# EAGLE schematic Resistor_Resistor (EAGLE 8.3.0), part 12 of 43
## Parts (continued)
R15918  10K  RESISTOR_0201  [0201]
R15919  10K  RESISTOR_0201  [0201]
R15920  10K  RESISTOR_0201  [0201]
R15921  10K  RESISTOR_0201  [0201]
R15922  10K  RESISTOR_0201  [0201]
R15923  10K  RESISTOR_0201  [0201]
R15924  10K  RESISTOR_0201  [0201]
R15925  10K  RESISTOR_0201  [0201]
R15926  10K  RESISTOR_0201  [0201]
R15927  10K  RESISTOR_0201  [0201]
R15928  10K  RESISTOR_0201  [0201]
R15929  10K  RESISTOR_0201  [0201]
R15930  10K  RESISTOR_0201  [0201]
R15931  10K  RESISTOR_0201  [0201]
R15932  10K  RESISTOR_0201  [0201]
R15933  10K  RESISTOR_0201  [0201]
R15934  10K  RESISTOR_0201  [0201]
R15935  10K  RESISTOR_0201  [0201]
R15936  10K  RESISTOR_0201  [0201]
R15937  10K  RESISTOR_0201  [0201]
R15938  10K  RESISTOR_0201  [0201]
R15939  10K  RESISTOR_0201  [0201]
R15940  10K  RESISTOR_0201  [0201]
R15941  10K  RESISTOR_0201  [0201]
R15942  10K  RESISTOR_0201  [0201]
R15943  10K  RESISTOR_0201  [0201]
R15944  10K  RESISTOR_0201  [0201]
R15945  10K  RESISTOR_0201  [0201]
R15946  10K  RESISTOR_0201  [0201]
R15947  10K  RESISTOR_0201  [0201]
R15948  10K  RESISTOR_0201  [0201]
R15949  10K  RESISTOR_0201  [0201]
R15950  10K  RESISTOR_0201  [0201]
R15951  10K  RESISTOR_0201  [0201]
R15952  10K  RESISTOR_0201  [0201]
R15953  10K  RESISTOR_0201  [0201]
R15954  10K  RESISTOR_0201  [0201]
R15955  10K  RESISTOR_0201  [0201]
R15956  10K  RESISTOR_0201  [0201]
R15957  10K  RESISTOR_0201  [0201]
R15958  10K  RESISTOR_0201  [0201]
R15959  10K  RESISTOR_0201  [0201]
R15960  10K  RESISTOR_0201  [0201]
R15961  10K  RESISTOR_0201  [0201]
R15962  10K  RESISTOR_0201  [0201]
R15963  10K  RESISTOR_0201  [0201]
R15964  10K  RESISTOR_0201  [0201]
R15965  10K  RESISTOR_0201  [0201]
R15966  10K  RESISTOR_0201  [0201]
R15967  10K  RESISTOR_0201  [0201]
R15968  10K  RESISTOR_0201  [0201]
R15969  10K  RESISTOR_0201  [0201]
R15970  10K  RESISTOR_0201  [0201]
R15971  10K  RESISTOR_0201  [0201]
R15972  10K  RESISTOR_0201  [0201]
R15973  10K  RESISTOR_0201  [0201]
R15974  10K  RESISTOR_0201  [0201]
R15975  10K  RESISTOR_0201  [0201]
R15976  10K  RESISTOR_0201  [0201]
R15977  10K  RESISTOR_0201  [0201]
R15978  10K  RESISTOR_0201  [0201]
R15979  10K  RESISTOR_0201  [0201]
R15980  10K  RESISTOR_0201  [0201]
R15981  10K  RESISTOR_0201  [0201]
R15982  10K  RESISTOR_0201  [0201]
R15983  10K  RESISTOR_0201  [0201]
R15984  10K  RESISTOR_0201  [0201]
R15985  10K  RESISTOR_0201  [0201]
R15986  10K  RESISTOR_0201  [0201]
R15987  10K  RESISTOR_0201  [0201]
R15988  10K  RESISTOR_0201  [0201]
R15989  10K  RESISTOR_0201  [0201]
R15990  10K  RESISTOR_0201  [0201]
R15991  10K  RESISTOR_0201  [0201]
R15992  10K  RESISTOR_0201  [0201]
R15993  10K  RESISTOR_0201  [0201]
R15994  10K  RESISTOR_0201  [0201]
R15995  10K  RESISTOR_0201  [0201]
R15996  10K  RESISTOR_0201  [0201]
R15997  10K  RESISTOR_0201  [0201]
R15998  10K  RESISTOR_0201  [0201]
R15999  10K  RESISTOR_0201  [0201]
R16000  10K  RESISTOR_0201  [0201]
R16001  10K  RESISTOR_0201  [0201]
R16002  10K  RESISTOR_0201  [0201]
R16003  10K  RESISTOR_0201  [0201]
R16004  10K  RESISTOR_0201  [0201]
R16005  10K  RESISTOR_0201  [0201]
R16006  10K  RESISTOR_0201  [0201]
R16007  10K  RESISTOR_0201  [0201]
R16008  10K  RESISTOR_0201  [0201]
R16009  10K  RESISTOR_0201  [0201]
R16010  10K  RESISTOR_0201  [0201]
R16011  10K  RESISTOR_0201  [0201]
R16012  10K  RESISTOR_0201  [0201]
R16013  10K  RESISTOR_0201  [0201]
R16014  10K  RESISTOR_0201  [0201]
R16015  10K  RESISTOR_0201  [0201]
R16016  10K  RESISTOR_0201  [0201]
R16017  10K  RESISTOR_0201  [0201]
R16018  10K  RESISTOR_0201  [0201]
R16019  10K  RESISTOR_0201  [0201]
R16020  10K  RESISTOR_0201  [0201]
R16021  10K  RESISTOR_0201  [0201]
R16022  10K  RESISTOR_0201  [0201]
R16023  10K  RESISTOR_0201  [0201]
R16024  10K  RESISTOR_0201  [0201]
R16025  10K  RESISTOR_0201  [0201]
R16026  10K  RESISTOR_0201  [0201]
R16027  10K  RESISTOR_0201  [0201]
R16028  10K  RESISTOR_0201  [0201]
R16029  10K  RESISTOR_0201  [0201]
R16030  10K  RESISTOR_0201  [0201]
R16031  10K  RESISTOR_0201  [0201]
R16032  10K  RESISTOR_0201  [0201]
R16033  10K  RESISTOR_0201  [0201]
R16034  10K  RESISTOR_0201  [0201]
R16035  10K  RESISTOR_0201  [0201]
R16036  10K  RESISTOR_0201  [0201]
R16037  10K  RESISTOR_0201  [0201]
R16038  10K  RESISTOR_0201  [0201]
R16039  10K  RESISTOR_0201  [0201]
R16040  10K  RESISTOR_0201  [0201]
R16041  10K  RESISTOR_0201  [0201]
R16042  10K  RESISTOR_0201  [0201]
R16043  10K  RESISTOR_0201  [0201]
R16044  10K  RESISTOR_0201  [0201]
R16045  10K  RESISTOR_0201  [0201]
R16046  10K  RESISTOR_0201  [0201]
R16047  10K  RESISTOR_0201  [0201]
R16048  10K  RESISTOR_0201  [0201]
R16049  10K  RESISTOR_0201  [0201]
R16050  10K  RESISTOR_0201  [0201]
R16051  10K  RESISTOR_0201  [0201]
R16052  10K  RESISTOR_0201  [0201]
R16053  10K  RESISTOR_0201  [0201]
R16054  10K  RESISTOR_0201  [0201]
R16055  10K  RESISTOR_0201  [0201]
R16056  10K  RESISTOR_0201  [0201]
R16057  10K  RESISTOR_0201  [0201]
R16058  10K  RESISTOR_0201  [0201]
R16059  10K  RESISTOR_0201  [0201]
R16060  10K  RESISTOR_0201  [0201]
R16061  10K  RESISTOR_0201  [0201]
R16062  10K  RESISTOR_0201  [0201]
R16063  10K  RESISTOR_0201  [0201]
R16064  10K  RESISTOR_0201  [0201]
R16065  10K  RESISTOR_0201  [0201]
R16066  10K  RESISTOR_0201  [0201]
R16067  10K  RESISTOR_0201  [0201]
R16068  10K  RESISTOR_0201  [0201]
R16069  10K  RESISTOR_0201  [0201]
R16070  10K  RESISTOR_0201  [0201]
R16071  10K  RESISTOR_0201  [0201]
R16072  10K  RESISTOR_0201  [0201]
R16073  10K  RESISTOR_0201  [0201]
R16074  10K  RESISTOR_0201  [0201]
R16075  10K  RESISTOR_0201  [0201]
R16076  10K  RESISTOR_0201  [0201]
R16077  10K  RESISTOR_0201  [0201]
R16078  10K  RESISTOR_0201  [0201]
R16079  10K  RESISTOR_0201  [0201]
R16080  10K  RESISTOR_0201  [0201]
R16081  10K  RESISTOR_0201  [0201]
R16082  10K  RESISTOR_0201  [0201]
R16083  10K  RESISTOR_0201  [0201]
R16084  10K  RESISTOR_0201  [0201]
R16085  10K  RESISTOR_0201  [0201]
R16086  10K  RESISTOR_0201  [0201]
R16087  10K  RESISTOR_0201  [0201]
R16088  10K  RESISTOR_0201  [0201]
R16089  10K  RESISTOR_0201  [0201]
R16090  10K  RESISTOR_0201  [0201]
R16091  10K  RESISTOR_0201  [0201]
R16092  10K  RESISTOR_0201  [0201]
R16093  10K  RESISTOR_0201  [0201]
R16094  10K  RESISTOR_0201  [0201]
R16095  10K  RESISTOR_0201  [0201]
R16096  10K  RESISTOR_0201  [0201]
R16097  10K  RESISTOR_0201  [0201]
R16098  10K  RESISTOR_0201  [0201]
R16099  10K  RESISTOR_0201  [0201]
R16100  10K  RESISTOR_0201  [0201]
R16101  10K  RESISTOR_0201  [0201]
R16102  10K  RESISTOR_0201  [0201]
R16103  10K  RESISTOR_0201  [0201]
R16104  10K  RESISTOR_0201  [0201]
R16105  10K  RESISTOR_0201  [0201]
R16106  10K  RESISTOR_0201  [0201]
R16107  10K  RESISTOR_0201  [0201]
R16108  10K  RESISTOR_0201  [0201]
R16109  10K  RESISTOR_0201  [0201]
R16110  10K  RESISTOR_0201  [0201]
R16111  10K  RESISTOR_0201  [0201]
R16112  10K  RESISTOR_0201  [0201]
R16113  10K  RESISTOR_0201  [0201]
R16114  10K  RESISTOR_0201  [0201]
R16115  10K  RESISTOR_0201  [0201]
R16116  10K  RESISTOR_0201  [0201]
R16117  10K  RESISTOR_0201  [0201]
R16118  10K  RESISTOR_0201  [0201]
R16119  10K  RESISTOR_0201  [0201]
R16120  10K  RESISTOR_0201  [0201]
R16121  10K  RESISTOR_0201  [0201]
R16122  10K  RESISTOR_0201  [0201]
R16123  10K  RESISTOR_0201  [0201]
R16124  10K  RESISTOR_0201  [0201]
R16125  10K  RESISTOR_0201  [0201]
R16126  10K  RESISTOR_0201  [0201]
R16127  10K  RESISTOR_0201  [0201]
R16128  10K  RESISTOR_0201  [0201]
R16129  10K  RESISTOR_0201  [0201]
R16130  10K  RESISTOR_0201  [0201]
R16131  10K  RESISTOR_0201  [0201]
R16132  10K  RESISTOR_0201  [0201]
R16133  10K  RESISTOR_0201  [0201]
R16134  10K  RESISTOR_0201  [0201]
R16135  10K  RESISTOR_0201  [0201]
R16136  10K  RESISTOR_0201  [0201]
R16137  10K  RESISTOR_0201  [0201]
R16138  10K  RESISTOR_0201  [0201]
R16139  10K  RESISTOR_0201  [0201]
R16140  10K  RESISTOR_0201  [0201]
R16141  10K  RESISTOR_0201  [0201]
R16142  10K  RESISTOR_0201  [0201]
R16143  10K  RESISTOR_0201  [0201]
R16144  10K  RESISTOR_0201  [0201]
R16145  10K  RESISTOR_0201  [0201]
R16146  10K  RESISTOR_0201  [0201]
R16147  10K  RESISTOR_0201  [0201]
R16148  10K  RESISTOR_0201  [0201]
R16149  10K  RESISTOR_0201  [0201]
R16150  10K  RESISTOR_0201  [0201]
R16151  10K  RESISTOR_0201  [0201]
R16152  10K  RESISTOR_0201  [0201]
R16153  10K  RESISTOR_0201  [0201]
R16154  10K  RESISTOR_0201  [0201]
R16155  10K  RESISTOR_0201  [0201]
R16156  10K  RESISTOR_0201  [0201]
R16157  10K  RESISTOR_0201  [0201]
R16158  10K  RESISTOR_0201  [0201]
R16159  10K  RESISTOR_0201  [0201]
R16160  10K  RESISTOR_0201  [0201]
R16161  10K  RESISTOR_0201  [0201]
R16162  10K  RESISTOR_0201  [0201]
R16163  10K  RESISTOR_0201  [0201]
R16164  10K  RESISTOR_0201  [0201]
R16165  10K  RESISTOR_0201  [0201]
R16166  10K  RESISTOR_0201  [0201]
R16167  10K  RESISTOR_0201  [0201]
R16168  10K  RESISTOR_0201  [0201]
R16169  10K  RESISTOR_0201  [0201]
R16170  10K  RESISTOR_0201  [0201]
R16171  10K  RESISTOR_0201  [0201]
R16172  10K  RESISTOR_0201  [0201]
R16173  10K  RESISTOR_0201  [0201]
R16174  10K  RESISTOR_0201  [0201]
R16175  10K  RESISTOR_0201  [0201]
R16176  10K  RESISTOR_0201  [0201]
R16177  10K  RESISTOR_0201  [0201]
R16178  10K  RESISTOR_0201  [0201]
R16179  10K  RESISTOR_0201  [0201]
R16180  10K  RESISTOR_0201  [0201]
R16181  10K  RESISTOR_0201  [0201]
R16182  10K  RESISTOR_0201  [0201]
R16183  10K  RESISTOR_0201  [0201]
R16184  10K  RESISTOR_0201  [0201]
R16185  10K  RESISTOR_0201  [0201]
R16186  10K  RESISTOR_0201  [0201]
R16187  10K  RESISTOR_0201  [0201]
R16188  10K  RESISTOR_0201  [0201]
R16189  10K  RESISTOR_0201  [0201]
R16190  10K  RESISTOR_0201  [0201]
R16191  10K  RESISTOR_0201  [0201]
R16192  10K  RESISTOR_0201  [0201]
R16193  10K  RESISTOR_0201  [0201]
R16194  10K  RESISTOR_0201  [0201]
R16195  10K  RESISTOR_0201  [0201]
R16196  10K  RESISTOR_0201  [0201]
R16197  10K  RESISTOR_0201  [0201]
R16198  10K  RESISTOR_0201  [0201]
R16199  10K  RESISTOR_0201  [0201]
R16200  10K  RESISTOR_0201  [0201]
R16201  10K  RESISTOR_0201  [0201]
R16202  10K  RESISTOR_0201  [0201]
R16203  10K  RESISTOR_0201  [0201]
R16204  10K  RESISTOR_0201  [0201]
R16205  10K  RESISTOR_0201  [0201]
R16206  10K  RESISTOR_0201  [0201]
R16207  10K  RESISTOR_0201  [0201]
R16208  10K  RESISTOR_0201  [0201]
R16209  10K  RESISTOR_0201  [0201]
R16210  10K  RESISTOR_0201  [0201]
R16211  10K  RESISTOR_0201  [0201]
R16212  10K  RESISTOR_0201  [0201]
R16213  10K  RESISTOR_0201  [0201]
R16214  10K  RESISTOR_0201  [0201]
R16215  10K  RESISTOR_0201  [0201]
R16216  10K  RESISTOR_0201  [0201]
R16217  10K  RESISTOR_0201  [0201]
R16218  10K  RESISTOR_0201  [0201]
R16219  10K  RESISTOR_0201  [0201]
R16220  10K  RESISTOR_0201  [0201]
R16221  10K  RESISTOR_0201  [0201]
R16222  10K  RESISTOR_0201  [0201]
R16223  10K  RESISTOR_0201  [0201]
R16224  10K  RESISTOR_0201  [0201]
R16225  10K  RESISTOR_0201  [0201]
R16226  10K  RESISTOR_0201  [0201]
R16227  10K  RESISTOR_0201  [0201]
R16228  10K  RESISTOR_0201  [0201]
R16229  10K  RESISTOR_0201  [0201]
R16230  10K  RESISTOR_0201  [0201]
R16231  10K  RESISTOR_0201  [0201]
R16232  10K  RESISTOR_0201  [0201]
R16233  10K  RESISTOR_0201  [0201]
R16234  10K  RESISTOR_0201  [0201]
R16235  10K  RESISTOR_0201  [0201]
R16236  10K  RESISTOR_0201  [0201]
R16237  10K  RESISTOR_0201  [0201]
R16238  10K  RESISTOR_0201  [0201]
R16239  10K  RESISTOR_0201  [0201]
R16240  10K  RESISTOR_0201  [0201]
R16241  10K  RESISTOR_0201  [0201]
R16242  10K  RESISTOR_0201  [0201]
R16243  10K  RESISTOR_0201  [0201]
R16244  10K  RESISTOR_0201  [0201]
R16245  10K  RESISTOR_0201  [0201]
R16246  10K  RESISTOR_0201  [0201]
R16247  10K  RESISTOR_0201  [0201]
R16248  10K  RESISTOR_0201  [0201]
R16249  10K  RESISTOR_0201  [0201]
R16250  10K  RESISTOR_0201  [0201]
R16251  10K  RESISTOR_0201  [0201]
R16252  10K  RESISTOR_0201  [0201]
R16253  10K  RESISTOR_0201  [0201]
R16254  10K  RESISTOR_0201  [0201]
R16255  10K  RESISTOR_0201  [0201]
R16256  10K  RESISTOR_0201  [0201]
R16257  10K  RESISTOR_0201  [0201]
R16258  10K  RESISTOR_0201  [0201]
R16259  10K  RESISTOR_0201  [0201]
R16260  10K  RESISTOR_0201  [0201]
R16261  10K  RESISTOR_0201  [0201]
R16262  10K  RESISTOR_0201  [0201]
R16263  10K  RESISTOR_0201  [0201]
R16264  10K  RESISTOR_0201  [0201]
R16265  10K  RESISTOR_0201  [0201]
R16266  10K  RESISTOR_0201  [0201]
R16267  10K  RESISTOR_0201  [0201]
R16268  10K  RESISTOR_0201  [0201]
R16269  10K  RESISTOR_0201  [0201]
R16270  10K  RESISTOR_0201  [0201]
R16271  10K  RESISTOR_0201  [0201]
R16272  10K  RESISTOR_0201  [0201]
R16273  10K  RESISTOR_0201  [0201]
R16274  10K  RESISTOR_0201  [0201]
R16275  10K  RESISTOR_0201  [0201]
R16276  10K  RESISTOR_0201  [0201]
R16277  10K  RESISTOR_0201  [0201]
R16278  10K  RESISTOR_0201  [0201]
R16279  10K  RESISTOR_0201  [0201]
R16280  10K  RESISTOR_0201  [0201]
R16281  10K  RESISTOR_0201  [0201]
R16282  10K  RESISTOR_0201  [0201]
R16283  10K  RESISTOR_0201  [0201]
R16284  10K  RESISTOR_0201  [0201]
R16285  10K  RESISTOR_0201  [0201]
R16286  10K  RESISTOR_0201  [0201]
R16287  10K  RESISTOR_0201  [0201]
R16288  10K  RESISTOR_0201  [0201]
R16289  10K  RESISTOR_0201  [0201]
R16290  10K  RESISTOR_0201  [0201]
R16291  10K  RESISTOR_0201  [0201]
R16292  10K  RESISTOR_0201  [0201]
R16293  10K  RESISTOR_0201  [0201]
R16294  10K  RESISTOR_0201  [0201]
R16295  10K  RESISTOR_0201  [0201]
R16296  10K  RESISTOR_0201  [0201]
R16297  10K  RESISTOR_0201  [0201]
R16298  10K  RESISTOR_0201  [0201]
R16299  10K  RESISTOR_0201  [0201]
R16300  10K  RESISTOR_0201  [0201]
R16301  10K  RESISTOR_0201  [0201]
R16302  10K  RESISTOR_0201  [0201]
R16303  10K  RESISTOR_0201  [0201]
R16304  10K  RESISTOR_0201  [0201]
R16305  10K  RESISTOR_0201  [0201]
R16306  10K  RESISTOR_0201  [0201]
R16307  10K  RESISTOR_0201  [0201]
R16308  10K  RESISTOR_0201  [0201]
R16309  10K  RESISTOR_0201  [0201]
R16310  10K  RESISTOR_0201  [0201]
R16311  10K  RESISTOR_0201  [0201]
R16312  10K  RESISTOR_0201  [0201]
R16313  10K  RESISTOR_0201  [0201]
R16314  10K  RESISTOR_0201  [0201]
R16315  10K  RESISTOR_0201  [0201]
R16316  10K  RESISTOR_0201  [0201]
R16317  10K  RESISTOR_0201  [0201]
R16318  10K  RESISTOR_0201  [0201]
R16319  10K  RESISTOR_0201  [0201]
R16320  10K  RESISTOR_0201  [0201]
R16321  10K  RESISTOR_0201  [0201]
R16322  10K  RESISTOR_0201  [0201]
R16323  10K  RESISTOR_0201  [0201]
R16324  10K  RESISTOR_0201  [0201]
R16325  10K  RESISTOR_0201  [0201]
R16326  10K  RESISTOR_0201  [0201]
R16327  10K  RESISTOR_0201  [0201]
R16328  10K  RESISTOR_0201  [0201]
R16329  10K  RESISTOR_0201  [0201]
R16330  10K  RESISTOR_0201  [0201]
R16331  10K  RESISTOR_0201  [0201]
R16332  10K  RESISTOR_0201  [0201]
R16333  10K  RESISTOR_0201  [0201]
R16334  10K  RESISTOR_0201  [0201]
R16335  10K  RESISTOR_0201  [0201]
R16336  10K  RESISTOR_0201  [0201]
R16337  10K  RESISTOR_0201  [0201]
R16338  10K  RESISTOR_0201  [0201]
R16339  10K  RESISTOR_0201  [0201]
R16340  10K  RESISTOR_0201  [0201]
R16341  10K  RESISTOR_0201  [0201]
R16342  10K  RESISTOR_0201  [0201]
R16343  10K  RESISTOR_0201  [0201]
R16344  10K  RESISTOR_0201  [0201]
R16345  10K  RESISTOR_0201  [0201]
R16346  10K  RESISTOR_0201  [0201]
R16347  10K  RESISTOR_0201  [0201]
R16348  10K  RESISTOR_0201  [0201]
R16349  10K  RESISTOR_0201  [0201]
R16350  10K  RESISTOR_0201  [0201]
R16351  10K  RESISTOR_0201  [0201]
R16352  10K  RESISTOR_0201  [0201]
R16353  10K  RESISTOR_0201  [0201]
R16354  10K  RESISTOR_0201  [0201]
R16355  10K  RESISTOR_0201  [0201]
R16356  10K  RESISTOR_0201  [0201]
R16357  10K  RESISTOR_0201  [0201]
R16358  10K  RESISTOR_0201  [0201]
R16359  10K  RESISTOR_0201  [0201]
R16360  10K  RESISTOR_0201  [0201]
R16361  10K  RESISTOR_0201  [0201]
R16362  10K  RESISTOR_0201  [0201]
R16363  10K  RESISTOR_0201  [0201]
R16364  10K  RESISTOR_0201  [0201]
R16365  10K  RESISTOR_0201  [0201]
R16366  10K  RESISTOR_0201  [0201]
R16367  10K  RESISTOR_0201  [0201]
R16368  10K  RESISTOR_0201  [0201]
R16369  10K  RESISTOR_0201  [0201]
R16370  10K  RESISTOR_0201  [0201]
R16371  10K  RESISTOR_0201  [0201]
R16372  10K  RESISTOR_0201  [0201]
R16373  10K  RESISTOR_0201  [0201]
R16374  10K  RESISTOR_0201  [0201]
R16375  10K  RESISTOR_0201  [0201]
R16376  10K  RESISTOR_0201  [0201]
R16377  10K  RESISTOR_0201  [0201]
R16378  10K  RESISTOR_0201  [0201]
R16379  10K  RESISTOR_0201  [0201]
R16380  10K  RESISTOR_0201  [0201]
R16381  10K  RESISTOR_0201  [0201]
R16382  10K  RESISTOR_0201  [0201]
R16383  10K  RESISTOR_0201  [0201]
R16384  10K  RESISTOR_0201  [0201]
R16385  10K  RESISTOR_0201  [0201]
R16386  10K  RESISTOR_0201  [0201]
R16387  10K  RESISTOR_0201  [0201]
R16388  10K  RESISTOR_0201  [0201]
R16389  10K  RESISTOR_0201  [0201]
R16390  10K  RESISTOR_0201  [0201]
R16391  10K  RESISTOR_0201  [0201]
R16392  10K  RESISTOR_0201  [0201]
R16393  10K  RESISTOR_0201  [0201]
R16394  10K  RESISTOR_0201  [0201]
R16395  10K  RESISTOR_0201  [0201]
R16396  10K  RESISTOR_0201  [0201]
R16397  10K  RESISTOR_0201  [0201]
R16398  10K  RESISTOR_0201  [0201]
R16399  10K  RESISTOR_0201  [0201]
R16400  10K  RESISTOR_0201  [0201]
R16401  10K  RESISTOR_0201  [0201]
R16402  10K  RESISTOR_0201  [0201]
R16403  10K  RESISTOR_0201  [0201]
R16404  10K  RESISTOR_0201  [0201]
R16405  10K  RESISTOR_0201  [0201]
R16406  10K  RESISTOR_0201  [0201]
R16407  10K  RESISTOR_0201  [0201]
R16408  10K  RESISTOR_0201  [0201]
R16409  10K  RESISTOR_0201  [0201]
R16410  10K  RESISTOR_0201  [0201]
R16411  10K  RESISTOR_0201  [0201]
R16412  10K  RESISTOR_0201  [0201]
R16413  10K  RESISTOR_0201  [0201]
R16414  10K  RESISTOR_0201  [0201]
R16415  10K  RESISTOR_0201  [0201]
R16416  10K  RESISTOR_0201  [0201]
R16417  10K  RESISTOR_0201  [0201]
R16418  10K  RESISTOR_0201  [0201]
R16419  10K  RESISTOR_0201  [0201]
R16420  10K  RESISTOR_0201  [0201]
R16421  10K  RESISTOR_0201  [0201]
R16422  10K  RESISTOR_0201  [0201]
R16423  10K  RESISTOR_0201  [0201]
R16424  10K  RESISTOR_0201  [0201]
R16425  10K  RESISTOR_0201  [0201]
R16426  10K  RESISTOR_0201  [0201]
R16427  10K  RESISTOR_0201  [0201]
R16428  10K  RESISTOR_0201  [0201]
R16429  10K  RESISTOR_0201  [0201]
R16430  10K  RESISTOR_0201  [0201]
R16431  10K  RESISTOR_0201  [0201]
R16432  10K  RESISTOR_0201  [0201]
R16433  10K  RESISTOR_0201  [0201]
R16434  10K  RESISTOR_0201  [0201]
R16435  10K  RESISTOR_0201  [0201]
R16436  10K  RESISTOR_0201  [0201]
R16437  10K  RESISTOR_0201  [0201]
R16438  10K  RESISTOR_0201  [0201]
R16439  10K  RESISTOR_0201  [0201]
R16440  10K  RESISTOR_0201  [0201]
R16441  10K  RESISTOR_0201  [0201]
R16442  10K  RESISTOR_0201  [0201]
R16443  10K  RESISTOR_0201  [0201]
R16444  10K  RESISTOR_0201  [0201]
R16445  10K  RESISTOR_0201  [0201]
R16446  10K  RESISTOR_0201  [0201]
R16447  10K  RESISTOR_0201  [0201]
R16448  10K  RESISTOR_0201  [0201]
R16449  10K  RESISTOR_0201  [0201]
R16450  10K  RESISTOR_0201  [0201]
R16451  10K  RESISTOR_0201  [0201]
R16452  10K  RESISTOR_0201  [0201]
R16453  10K  RESISTOR_0201  [0201]
R16454  10K  RESISTOR_0201  [0201]
R16455  10K  RESISTOR_0201  [0201]
R16456  10K  RESISTOR_0201  [0201]
R16457  10K  RESISTOR_0201  [0201]
R16458  10K  RESISTOR_0201  [0201]
R16459  10K  RESISTOR_0201  [0201]
R16460  10K  RESISTOR_0201  [0201]
R16461  10K  RESISTOR_0201  [0201]
R16462  10K  RESISTOR_0201  [0201]
R16463  10K  RESISTOR_0201  [0201]
R16464  10K  RESISTOR_0201  [0201]
R16465  10K  RESISTOR_0201  [0201]
R16466  10K  RESISTOR_0201  [0201]
R16467  10K  RESISTOR_0201  [0201]
R16468  10K  RESISTOR_0201  [0201]
R16469  10K  RESISTOR_0201  [0201]
R16470  10K  RESISTOR_0201  [0201]
R16471  10K  RESISTOR_0201  [0201]
R16472  10K  RESISTOR_0201  [0201]
R16473  10K  RESISTOR_0201  [0201]
R16474  10K  RESISTOR_0201  [0201]
R16475  10K  RESISTOR_0201  [0201]
R16476  10K  RESISTOR_0201  [0201]
R16477  10K  RESISTOR_0201  [0201]
R16478  10K  RESISTOR_0201  [0201]
R16479  10K  RESISTOR_0201  [0201]
R16480  10K  RESISTOR_0201  [0201]
R16481  10K  RESISTOR_0201  [0201]
R16482  10K  RESISTOR_0201  [0201]
R16483  10K  RESISTOR_0201  [0201]
R16484  10K  RESISTOR_0201  [0201]
R16485  10K  RESISTOR_0201  [0201]
R16486  10K  RESISTOR_0201  [0201]
R16487  10K  RESISTOR_0201  [0201]
R16488  10K  RESISTOR_0201  [0201]
R16489  10K  RESISTOR_0201  [0201]
R16490  10K  RESISTOR_0201  [0201]
R16491  10K  RESISTOR_0201  [0201]
R16492  10K  RESISTOR_0201  [0201]
R16493  10K  RESISTOR_0201  [0201]
R16494  10K  RESISTOR_0201  [0201]
R16495  10K  RESISTOR_0201  [0201]
R16496  10K  RESISTOR_0201  [0201]
R16497  10K  RESISTOR_0201  [0201]
R16498  10K  RESISTOR_0201  [0201]
R16499  10K  RESISTOR_0201  [0201]
R16500  10K  RESISTOR_0201  [0201]
R16501  10K  RESISTOR_0201  [0201]
R16502  10K  RESISTOR_0201  [0201]
R16503  10K  RESISTOR_0201  [0201]
R16504  10K  RESISTOR_0201  [0201]
R16505  10K  RESISTOR_0201  [0201]
R16506  10K  RESISTOR_0201  [0201]
R16507  10K  RESISTOR_0201  [0201]
R16508  10K  RESISTOR_0201  [0201]
R16509  10K  RESISTOR_0201  [0201]
R16510  10K  RESISTOR_0201  [0201]
R16511  10K  RESISTOR_0201  [0201]
R16512  10K  RESISTOR_0201  [0201]
R16513  10K  RESISTOR_0201  [0201]
R16514  10K  RESISTOR_0201  [0201]
R16515  10K  RESISTOR_0201  [0201]
R16516  10K  RESISTOR_0201  [0201]
R16517  10K  RESISTOR_0201  [0201]
R16518  10K  RESISTOR_0201  [0201]
R16519  10K  RESISTOR_0201  [0201]
R16520  10K  RESISTOR_0201  [0201]
R16521  10K  RESISTOR_0201  [0201]
R16522  10K  RESISTOR_0201  [0201]
R16523  10K  RESISTOR_0201  [0201]
R16524  10K  RESISTOR_0201  [0201]
R16525  10K  RESISTOR_0201  [0201]
R16526  10K  RESISTOR_0201  [0201]
R16527  10K  RESISTOR_0201  [0201]
R16528  10K  RESISTOR_0201  [0201]
R16529  10K  RESISTOR_0201  [0201]
R16530  10K  RESISTOR_0201  [0201]
R16531  10K  RESISTOR_0201  [0201]
R16532  10K  RESISTOR_0201  [0201]
R16533  10K  RESISTOR_0201  [0201]
R16534  10K  RESISTOR_0201  [0201]
R16535  10K  RESISTOR_0201  [0201]
R16536  10K  RESISTOR_0201  [0201]
R16537  10K  RESISTOR_0201  [0201]
R16538  10K  RESISTOR_0201  [0201]
R16539  10K  RESISTOR_0201  [0201]
R16540  10K  RESISTOR_0201  [0201]
R16541  10K  RESISTOR_0201  [0201]
R16542  10K  RESISTOR_0201  [0201]
R16543  10K  RESISTOR_0201  [0201]
R16544  10K  RESISTOR_0201  [0201]
R16545  10K  RESISTOR_0201  [0201]
R16546  10K  RESISTOR_0201  [0201]
R16547  10K  RESISTOR_0201  [0201]
R16548  10K  RESISTOR_0201  [0201]
R16549  10K  RESISTOR_0201  [0201]
R16550  10K  RESISTOR_0201  [0201]
R16551  10K  RESISTOR_0201  [0201]
R16552  10K  RESISTOR_0201  [0201]
R16553  10K  RESISTOR_0201  [0201]
R16554  10K  RESISTOR_0201  [0201]
R16555  10K  RESISTOR_0201  [0201]
R16556  10K  RESISTOR_0201  [0201]
R16557  10K  RESISTOR_0201  [0201]
R16558  10K  RESISTOR_0201  [0201]
R16559  10K  RESISTOR_0201  [0201]
R16560  10K  RESISTOR_0201  [0201]
R16561  10K  RESISTOR_0201  [0201]
R16562  10K  RESISTOR_0201  [0201]
R16563  10K  RESISTOR_0201  [0201]
R16564  10K  RESISTOR_0201  [0201]
R16565  10K  RESISTOR_0201  [0201]
R16566  10K  RESISTOR_0201  [0201]
R16567  10K  RESISTOR_0201  [0201]
R16568  10K  RESISTOR_0201  [0201]
R16569  10K  RESISTOR_0201  [0201]
R16570  10K  RESISTOR_0201  [0201]
R16571  10K  RESISTOR_0201  [0201]
R16572  10K  RESISTOR_0201  [0201]
R16573  10K  RESISTOR_0201  [0201]
R16574  10K  RESISTOR_0201  [0201]
R16575  10K  RESISTOR_0201  [0201]
R16576  10K  RESISTOR_0201  [0201]
R16577  10K  RESISTOR_0201  [0201]
R16578  10K  RESISTOR_0201  [0201]
R16579  10K  RESISTOR_0201  [0201]
R16580  10K  RESISTOR_0201  [0201]
R16581  10K  RESISTOR_0201  [0201]
R16582  10K  RESISTOR_0201  [0201]
R16583  10K  RESISTOR_0201  [0201]
R16584  10K  RESISTOR_0201  [0201]
R16585  10K  RESISTOR_0201  [0201]
R16586  10K  RESISTOR_0201  [0201]
R16587  10K  RESISTOR_0201  [0201]
R16588  10K  RESISTOR_0201  [0201]
R16589  10K  RESISTOR_0201  [0201]
R16590  10K  RESISTOR_0201  [0201]
R16591  10K  RESISTOR_0201  [0201]
R16592  10K  RESISTOR_0201  [0201]
R16593  10K  RESISTOR_0201  [0201]
R16594  10K  RESISTOR_0201  [0201]
R16595  10K  RESISTOR_0201  [0201]
R16596  10K  RESISTOR_0201  [0201]
R16597  10K  RESISTOR_0201  [0201]
R16598  10K  RESISTOR_0201  [0201]
R16599  10K  RESISTOR_0201  [0201]
R16600  10K  RESISTOR_0201  [0201]
R16601  10K  RESISTOR_0201  [0201]
R16602  10K  RESISTOR_0201  [0201]
R16603  10K  RESISTOR_0201  [0201]
R16604  10K  RESISTOR_0201  [0201]
R16605  10K  RESISTOR_0201  [0201]
R16606  10K  RESISTOR_0201  [0201]
R16607  10K  RESISTOR_0201  [0201]
R16608  10K  RESISTOR_0201  [0201]
R16609  10K  RESISTOR_0201  [0201]
R16610  10K  RESISTOR_0201  [0201]
R16611  10K  RESISTOR_0201  [0201]
R16612  10K  RESISTOR_0201  [0201]
R16613  10K  RESISTOR_0201  [0201]
R16614  10K  RESISTOR_0201  [0201]
R16615  10K  RESISTOR_0201  [0201]
R16616  10K  RESISTOR_0201  [0201]
R16617  10K  RESISTOR_0201  [0201]
R16618  10K  RESISTOR_0201  [0201]
R16619  10K  RESISTOR_0201  [0201]
R16620  10K  RESISTOR_0201  [0201]
R16621  10K  RESISTOR_0201  [0201]
R16622  10K  RESISTOR_0201  [0201]
R16623  10K  RESISTOR_0201  [0201]
R16624  10K  RESISTOR_0201  [0201]
R16625  10K  RESISTOR_0201  [0201]
R16626  10K  RESISTOR_0201  [0201]
R16627  10K  RESISTOR_0201  [0201]
R16628  10K  RESISTOR_0201  [0201]
R16629  10K  RESISTOR_0201  [0201]
R16630  10K  RESISTOR_0201  [0201]
R16631  10K  RESISTOR_0201  [0201]
R16632  10K  RESISTOR_0201  [0201]
R16633  10K  RESISTOR_0201  [0201]
R16634  10K  RESISTOR_0201  [0201]
R16635  10K  RESISTOR_0201  [0201]
R16636  10K  RESISTOR_0201  [0201]
R16637  10K  RESISTOR_0201  [0201]
R16638  10K  RESISTOR_0201  [0201]
R16639  10K  RESISTOR_0201  [0201]
R16640  10K  RESISTOR_0201  [0201]
R16641  10K  RESISTOR_0201  [0201]
R16642  10K  RESISTOR_0201  [0201]
R16643  10K  RESISTOR_0201  [0201]
R16644  10K  RESISTOR_0201  [0201]
R16645  10K  RESISTOR_0201  [0201]
R16646  10K  RESISTOR_0201  [0201]
R16647  10K  RESISTOR_0201  [0201]
R16648  10K  RESISTOR_0201  [0201]
R16649  10K  RESISTOR_0201  [0201]
R16650  10K  RESISTOR_0201  [0201]
R16651  10K  RESISTOR_0201  [0201]
R16652  10K  RESISTOR_0201  [0201]
R16653  10K  RESISTOR_0201  [0201]
R16654  10K  RESISTOR_0201  [0201]
R16655  10K  RESISTOR_0201  [0201]
R16656  10K  RESISTOR_0201  [0201]
R16657  10K  RESISTOR_0201  [0201]
R16658  10K  RESISTOR_0201  [0201]
R16659  10K  RESISTOR_0201  [0201]
R16660  10K  RESISTOR_0201  [0201]
R16661  10K  RESISTOR_0201  [0201]
R16662  10K  RESISTOR_0201  [0201]
R16663  10K  RESISTOR_0201  [0201]
R16664  10K  RESISTOR_0201  [0201]
R16665  10K  RESISTOR_0201  [0201]
R16666  10K  RESISTOR_0201  [0201]
R16667  10K  RESISTOR_0201  [0201]
R16668  10K  RESISTOR_0201  [0201]
R16669  10K  RESISTOR_0201  [0201]
R16670  10K  RESISTOR_0201  [0201]
R16671  10K  RESISTOR_0201  [0201]
R16672  10K  RESISTOR_0201  [0201]
R16673  10K  RESISTOR_0201  [0201]
R16674  10K  RESISTOR_0201  [0201]
R16675  10K  RESISTOR_0201  [0201]
R16676  10K  RESISTOR_0201  [0201]
R16677  10K  RESISTOR_0201  [0201]
R16678  10K  RESISTOR_0201  [0201]
R16679  10K  RESISTOR_0201  [0201]
R16680  10K  RESISTOR_0201  [0201]
R16681  10K  RESISTOR_0201  [0201]
R16682  10K  RESISTOR_0201  [0201]
R16683  10K  RESISTOR_0201  [0201]
R16684  10K  RESISTOR_0201  [0201]
R16685  10K  RESISTOR_0201  [0201]
R16686  10K  RESISTOR_0201  [0201]
R16687  10K  RESISTOR_0201  [0201]
R16688  10K  RESISTOR_0201  [0201]
R16689  10K  RESISTOR_0201  [0201]
R16690  10K  RESISTOR_0201  [0201]
R16691  10K  RESISTOR_0201  [0201]
R16692  10K  RESISTOR_0201  [0201]
R16693  10K  RESISTOR_0201  [0201]
R16694  10K  RESISTOR_0201  [0201]
R16695  10K  RESISTOR_0201  [0201]
R16696  10K  RESISTOR_0201  [0201]
R16697  10K  RESISTOR_0201  [0201]
R16698  10K  RESISTOR_0201  [0201]
R16699  10K  RESISTOR_0201  [0201]
R16700  10K  RESISTOR_0201  [0201]
R16701  10K  RESISTOR_0201  [0201]
R16702  10K  RESISTOR_0201  [0201]
R16703  10K  RESISTOR_0201  [0201]
R16704  10K  RESISTOR_0201  [0201]
R16705  10K  RESISTOR_0201  [0201]
R16706  10K  RESISTOR_0201  [0201]
R16707  10K  RESISTOR_0201  [0201]
R16708  10K  RESISTOR_0201  [0201]
R16709  10K  RESISTOR_0201  [0201]
R16710  10K  RESISTOR_0201  [0201]
R16711  10K  RESISTOR_0201  [0201]
R16712  10K  RESISTOR_0201  [0201]
R16713  10K  RESISTOR_0201  [0201]
R16714  10K  RESISTOR_0201  [0201]
R16715  10K  RESISTOR_0201  [0201]
R16716  10K  RESISTOR_0201  [0201]
R16717  10K  RESISTOR_0201  [0201]
R16718  10K  RESISTOR_0201  [0201]
R16719  10K  RESISTOR_0201  [0201]
R16720  10K  RESISTOR_0201  [0201]
R16721  10K  RESISTOR_0201  [0201]
R16722  10K  RESISTOR_0201  [0201]
R16723  10K  RESISTOR_0201  [0201]
R16724  10K  RESISTOR_0201  [0201]
R16725  10K  RESISTOR_0201  [0201]
R16726  10K  RESISTOR_0201  [0201]
R16727  10K  RESISTOR_0201  [0201]
R16728  10K  RESISTOR_0201  [0201]
R16729  10K  RESISTOR_0201  [0201]
R16730  10K  RESISTOR_0201  [0201]
R16731  10K  RESISTOR_0201  [0201]
R16732  10K  RESISTOR_0201  [0201]
R16733  10K  RESISTOR_0201  [0201]
R16734  10K  RESISTOR_0201  [0201]
R16735  10K  RESISTOR_0201  [0201]
R16736  10K  RESISTOR_0201  [0201]
R16737  10K  RESISTOR_0201  [0201]
R16738  10K  RESISTOR_0201  [0201]
R16739  10K  RESISTOR_0201  [0201]
R16740  10K  RESISTOR_0201  [0201]
R16741  10K  RESISTOR_0201  [0201]
R16742  10K  RESISTOR_0201  [0201]
R16743  10K  RESISTOR_0201  [0201]
R16744  10K  RESISTOR_0201  [0201]
R16745  10K  RESISTOR_0201  [0201]
R16746  10K  RESISTOR_0201  [0201]
R16747  10K  RESISTOR_0201  [0201]
R16748  10K  RESISTOR_0201  [0201]
R16749  10K  RESISTOR_0201  [0201]
R16750  10K  RESISTOR_0201  [0201]
R16751  10K  RESISTOR_0201  [0201]
R16752  10K  RESISTOR_0201  [0201]
R16753  10K  RESISTOR_0201  [0201]
R16754  10K  RESISTOR_0201  [0201]
R16755  10K  RESISTOR_0201  [0201]
R16756  10K  RESISTOR_0201  [0201]
R16757  10K  RESISTOR_0201  [0201]
R16758  10K  RESISTOR_0201  [0201]
R16759  10K  RESISTOR_0201  [0201]
R16760  10K  RESISTOR_0201  [0201]
R16761  10K  RESISTOR_0201  [0201]
R16762  10K  RESISTOR_0201  [0201]
R16763  10K  RESISTOR_0201  [0201]
R16764  10K  RESISTOR_0201  [0201]
R16765  10K  RESISTOR_0201  [0201]
R16766  10K  RESISTOR_0201  [0201]
R16767  10K  RESISTOR_0201  [0201]
R16768  10K  RESISTOR_0201  [0201]
R16769  10K  RESISTOR_0201  [0201]
R16770  10K  RESISTOR_0201  [0201]
R16771  10K  RESISTOR_0201  [0201]
R16772  10K  RESISTOR_0201  [0201]
R16773  10K  RESISTOR_0201  [0201]
R16774  10K  RESISTOR_0201  [0201]
R16775  10K  RESISTOR_0201  [0201]
R16776  10K  RESISTOR_0201  [0201]
R16777  10K  RESISTOR_0201  [0201]
R16778  10K  RESISTOR_0201  [0201]
R16779  10K  RESISTOR_0201  [0201]
R16780  10K  RESISTOR_0201  [0201]
R16781  10K  RESISTOR_0201  [0201]
R16782  10K  RESISTOR_0201  [0201]
R16783  10K  RESISTOR_0201  [0201]
R16784  10K  RESISTOR_0201  [0201]
R16785  10K  RESISTOR_0201  [0201]
R16786  10K  RESISTOR_0201  [0201]
R16787  10K  RESISTOR_0201  [0201]
R16788  10K  RESISTOR_0201  [0201]
R16789  10K  RESISTOR_0201  [0201]
R16790  10K  RESISTOR_0201  [0201]
R16791  10K  RESISTOR_0201  [0201]
R16792  10K  RESISTOR_0201  [0201]
R16793  10K  RESISTOR_0201  [0201]
R16794  10K  RESISTOR_0201  [0201]
R16795  10K  RESISTOR_0201  [0201]
R16796  10K  RESISTOR_0201  [0201]
R16797  10K  RESISTOR_0201  [0201]
R16798  10K  RESISTOR_0201  [0201]
R16799  10K  RESISTOR_0201  [0201]
R16800  10K  RESISTOR_0201  [0201]
R16801  10K  RESISTOR_0201  [0201]
R16802  10K  RESISTOR_0201  [0201]
R16803  10K  RESISTOR_0201  [0201]
R16804  10K  RESISTOR_0201  [0201]
R16805  10K  RESISTOR_0201  [0201]
R16806  10K  RESISTOR_0201  [0201]
R16807  10K  RESISTOR_0201  [0201]
R16808  10K  RESISTOR_0201  [0201]
R16809  10K  RESISTOR_0201  [0201]
R16810  10K  RESISTOR_0201  [0201]
R16811  10K  RESISTOR_0201  [0201]
R16812  10K  RESISTOR_0201  [0201]
R16813  10K  RESISTOR_0201  [0201]
R16814  10K  RESISTOR_0201  [0201]
R16815  10K  RESISTOR_0201  [0201]
R16816  10K  RESISTOR_0201  [0201]
R16817  10K  RESISTOR_0201  [0201]
R16818  10K  RESISTOR_0201  [0201]
R16819  10K  RESISTOR_0201  [0201]
R16820  10K  RESISTOR_0201  [0201]
R16821  10K  RESISTOR_0201  [0201]
R16822  10K  RESISTOR_0201  [0201]
R16823  10K  RESISTOR_0201  [0201]
R16824  10K  RESISTOR_0201  [0201]
R16825  10K  RESISTOR_0201  [0201]
R16826  10K  RESISTOR_0201  [0201]
R16827  10K  RESISTOR_0201  [0201]
R16828  10K  RESISTOR_0201  [0201]
R16829  10K  RESISTOR_0201  [0201]
R16830  10K  RESISTOR_0201  [0201]
R16831  10K  RESISTOR_0201  [0201]
R16832  10K  RESISTOR_0201  [0201]
R16833  10K  RESISTOR_0201  [0201]
R16834  10K  RESISTOR_0201  [0201]
R16835  10K  RESISTOR_0201  [0201]
R16836  10K  RESISTOR_0201  [0201]
R16837  10K  RESISTOR_0201  [0201]
R16838  10K  RESISTOR_0201  [0201]
R16839  10K  RESISTOR_0201  [0201]
R16840  10K  RESISTOR_0201  [0201]
R16841  10K  RESISTOR_0201  [0201]
R16842  10K  RESISTOR_0201  [0201]
R16843  10K  RESISTOR_0201  [0201]
R16844  10K  RESISTOR_0201  [0201]
R16845  10K  RESISTOR_0201  [0201]
R16846  10K  RESISTOR_0201  [0201]
R16847  10K  RESISTOR_0201  [0201]
R16848  10K  RESISTOR_0201  [0201]
R16849  10K  RESISTOR_0201  [0201]
R16850  10K  RESISTOR_0201  [0201]
R16851  10K  RESISTOR_0201  [0201]
R16852  10K  RESISTOR_0201  [0201]
R16853  10K  RESISTOR_0201  [0201]
R16854  10K  RESISTOR_0201  [0201]
R16855  10K  RESISTOR_0201  [0201]
R16856  10K  RESISTOR_0201  [0201]
R16857  10K  RESISTOR_0201  [0201]
R16858  10K  RESISTOR_0201  [0201]
R16859  10K  RESISTOR_0201  [0201]
R16860  10K  RESISTOR_0201  [0201]
R16861  10K  RESISTOR_0201  [0201]
R16862  10K  RESISTOR_0201  [0201]
R16863  10K  RESISTOR_0201  [0201]
R16864  10K  RESISTOR_0201  [0201]
R16865  10K  RESISTOR_0201  [0201]
R16866  10K  RESISTOR_0201  [0201]
R16867  10K  RESISTOR_0201  [0201]
R16868  10K  RESISTOR_0201  [0201]
R16869  10K  RESISTOR_0201  [0201]
R16870  10K  RESISTOR_0201  [0201]
R16871  10K  RESISTOR_0201  [0201]
R16872  10K  RESISTOR_0201  [0201]
R16873  10K  RESISTOR_0201  [0201]
R16874  10K  RESISTOR_0201  [0201]
R16875  10K  RESISTOR_0201  [0201]
R16876  10K  RESISTOR_0201  [0201]
R16877  10K  RESISTOR_0201  [0201]
R16878  10K  RESISTOR_0201  [0201]
R16879  10K  RESISTOR_0201  [0201]
R16880  10K  RESISTOR_0201  [0201]
R16881  10K  RESISTOR_0201  [0201]
R16882  10K  RESISTOR_0201  [0201]
R16883  10K  RESISTOR_0201  [0201]
R16884  10K  RESISTOR_0201  [0201]
R16885  10K  RESISTOR_0201  [0201]
R16886  10K  RESISTOR_0201  [0201]
R16887  10K  RESISTOR_0201  [0201]
R16888  10K  RESISTOR_0201  [0201]
R16889  10K  RESISTOR_0201  [0201]
R16890  10K  RESISTOR_0201  [0201]
R16891  10K  RESISTOR_0201  [0201]
R16892  10K  RESISTOR_0201  [0201]
R16893  10K  RESISTOR_0201  [0201]
R16894  10K  RESISTOR_0201  [0201]
R16895  10K  RESISTOR_0201  [0201]
R16896  10K  RESISTOR_0201  [0201]
R16897  10K  RESISTOR_0201  [0201]
R16898  10K  RESISTOR_0201  [0201]
R16899  10K  RESISTOR_0201  [0201]
R16900  10K  RESISTOR_0201  [0201]
R16901  10K  RESISTOR_0201  [0201]
R16902  10K  RESISTOR_0201  [0201]
R16903  10K  RESISTOR_0201  [0201]
R16904  10K  RESISTOR_0201  [0201]
R16905  10K  RESISTOR_0201  [0201]
R16906  10K  RESISTOR_0201  [0201]
R16907  10K  RESISTOR_0201  [0201]
R16908  10K  RESISTOR_0201  [0201]
R16909  10K  RESISTOR_0201  [0201]
R16910  10K  RESISTOR_0201  [0201]
R16911  10K  RESISTOR_0201  [0201]
R16912  10K  RESISTOR_0201  [0201]
R16913  10K  RESISTOR_0201  [0201]
R16914  10K  RESISTOR_0201  [0201]
R16915  10K  RESISTOR_0201  [0201]
R16916  10K  RESISTOR_0201  [0201]
R16917  10K  RESISTOR_0201  [0201]
R16918  10K  RESISTOR_0201  [0201]
R16919  10K  RESISTOR_0201  [0201]
R16920  10K  RESISTOR_0201  [0201]
R16921  10K  RESISTOR_0201  [0201]
R16922  10K  RESISTOR_0201  [0201]
R16923  10K  RESISTOR_0201  [0201]
R16924  10K  RESISTOR_0201  [0201]
R16925  10K  RESISTOR_0201  [0201]
R16926  10K  RESISTOR_0201  [0201]
R16927  10K  RESISTOR_0201  [0201]
R16928  10K  RESISTOR_0201  [0201]
R16929  10K  RESISTOR_0201  [0201]
R16930  10K  RESISTOR_0201  [0201]
R16931  10K  RESISTOR_0201  [0201]
R16932  10K  RESISTOR_0201  [0201]
R16933  10K  RESISTOR_0201  [0201]
R16934  10K  RESISTOR_0201  [0201]
R16935  10K  RESISTOR_0201  [0201]
R16936  10K  RESISTOR_0201  [0201]
R16937  10K  RESISTOR_0201  [0201]
R16938  10K  RESISTOR_0201  [0201]
R16939  10K  RESISTOR_0201  [0201]
R16940  10K  RESISTOR_0201  [0201]
R16941  10K  RESISTOR_0201  [0201]
R16942  10K  RESISTOR_0201  [0201]
R16943  10K  RESISTOR_0201  [0201]
R16944  10K  RESISTOR_0201  [0201]
R16945  10K  RESISTOR_0201  [0201]
R16946  10K  RESISTOR_0201  [0201]
R16947  10K  RESISTOR_0201  [0201]
R16948  10K  RESISTOR_0201  [0201]
R16949  10K  RESISTOR_0201  [0201]
R16950  10K  RESISTOR_0201  [0201]
R16951  10K  RESISTOR_0201  [0201]
R16952  10K  RESISTOR_0201  [0201]
R16953  10K  RESISTOR_0201  [0201]
R16954  10K  RESISTOR_0201  [0201]
R16955  10K  RESISTOR_0201  [0201]
R16956  10K  RESISTOR_0201  [0201]
R16957  10K  RESISTOR_0201  [0201]
R16958  10K  RESISTOR_0201  [0201]
R16959  10K  RESISTOR_0201  [0201]
R16960  10K  RESISTOR_0201  [0201]
R16961  10K  RESISTOR_0201  [0201]
R16962  10K  RESISTOR_0201  [0201]
R16963  10K  RESISTOR_0201  [0201]
R16964  10K  RESISTOR_0201  [0201]
R16965  10K  RESISTOR_0201  [0201]
R16966  10K  RESISTOR_0201  [0201]
R16967  10K  RESISTOR_0201  [0201]
R16968  10K  RESISTOR_0201  [0201]
R16969  10K  RESISTOR_0201  [0201]
R16970  10K  RESISTOR_0201  [0201]
R16971  10K  RESISTOR_0201  [0201]
R16972  10K  RESISTOR_0201  [0201]
R16973  10K  RESISTOR_0201  [0201]
R16974  10K  RESISTOR_0201  [0201]
R16975  10K  RESISTOR_0201  [0201]
R16976  10K  RESISTOR_0201  [0201]
R16977  10K  RESISTOR_0201  [0201]
R16978  10K  RESISTOR_0201  [0201]
R16979  10K  RESISTOR_0201  [0201]
R16980  10K  RESISTOR_0201  [0201]
R16981  10K  RESISTOR_0201  [0201]
R16982  10K  RESISTOR_0201  [0201]
R16983  10K  RESISTOR_0201  [0201]
R16984  10K  RESISTOR_0201  [0201]
R16985  10K  RESISTOR_0201  [0201]
R16986  10K  RESISTOR_0201  [0201]
R16987  10K  RESISTOR_0201  [0201]
R16988  10K  RESISTOR_0201  [0201]
R16989  10K  RESISTOR_0201  [0201]
R16990  10K  RESISTOR_0201  [0201]
R16991  10K  RESISTOR_0201  [0201]
R16992  10K  RESISTOR_0201  [0201]
R16993  10K  RESISTOR_0201  [0201]
R16994  10K  RESISTOR_0201  [0201]
R16995  10K  RESISTOR_0201  [0201]
R16996  10K  RESISTOR_0201  [0201]
R16997  10K  RESISTOR_0201  [0201]
R16998  10K  RESISTOR_0201  [0201]
R16999  10K  RESISTOR_0201  [0201]
R17000  10K  RESISTOR_0201  [0201]
R17001  10K  RESISTOR_0201  [0201]
R17002  10K  RESISTOR_0201  [0201]
R17003  10K  RESISTOR_0201  [0201]
R17004  10K  RESISTOR_0201  [0201]
R17005  10K  RESISTOR_0201  [0201]
R17006  10K  RESISTOR_0201  [0201]
R17007  10K  RESISTOR_0201  [0201]
R17008  10K  RESISTOR_0201  [0201]
R17009  10K  RESISTOR_0201  [0201]
R17010  10K  RESISTOR_0201  [0201]
R17011  10K  RESISTOR_0201  [0201]
R17012  10K  RESISTOR_0201  [0201]
R17013  10K  RESISTOR_0201  [0201]
R17014  10K  RESISTOR_0201  [0201]
R17015  10K  RESISTOR_0201  [0201]
R17016  10K  RESISTOR_0201  [0201]
R17017  10K  RESISTOR_0201  [0201]
R17018  10K  RESISTOR_0201  [0201]
R17019  10K  RESISTOR_0201  [0201]
R17020  10K  RESISTOR_0201  [0201]
R17021  10K  RESISTOR_0201  [0201]
R17022  10K  RESISTOR_0201  [0201]
R17023  10K  RESISTOR_0201  [0201]
R17024  10K  RESISTOR_0201  [0201]
R17025  10K  RESISTOR_0201  [0201]
R17026  10K  RESISTOR_0201  [0201]
R17027  10K  RESISTOR_0201  [0201]
R17028  10K  RESISTOR_0201  [0201]
R17029  10K  RESISTOR_0201  [0201]
R17030  10K  RESISTOR_0201  [0201]
R17031  10K  RESISTOR_0201  [0201]
R17032  10K  RESISTOR_0201  [0201]
R17033  10K  RESISTOR_0201  [0201]
R17034  10K  RESISTOR_0201  [0201]
R17035  10K  RESISTOR_0201  [0201]
R17036  10K  RESISTOR_0201  [0201]
R17037  10K  RESISTOR_0201  [0201]
R17038  10K  RESISTOR_0201  [0201]
R17039  10K  RESISTOR_0201  [0201]
R17040  10K  RESISTOR_0201  [0201]
R17041  10K  RESISTOR_0201  [0201]
R17042  10K  RESISTOR_0201  [0201]
R17043  10K  RESISTOR_0201  [0201]
R17044  10K  RESISTOR_0201  [0201]
R17045  10K  RESISTOR_0201  [0201]
R17046  10K  RESISTOR_0201  [0201]
R17047  10K  RESISTOR_0201  [0201]
R17048  10K  RESISTOR_0201  [0201]
R17049  10K  RESISTOR_0201  [0201]
R17050  10K  RESISTOR_0201  [0201]
R17051  10K  RESISTOR_0201  [0201]
R17052  10K  RESISTOR_0201  [0201]
R17053  10K  RESISTOR_0201  [0201]
R17054  10K  RESISTOR_0201  [0201]
R17055  10K  RESISTOR_0201  [0201]
R17056  10K  RESISTOR_0201  [0201]
R17057  10K  RESISTOR_0201  [0201]
R17058  10K  RESISTOR_0201  [0201]
R17059  10K  RESISTOR_0201  [0201]
R17060  10K  RESISTOR_0201  [0201]
R17061  10K  RESISTOR_0201  [0201]
R17062  10K  RESISTOR_0201  [0201]
R17063  10K  RESISTOR_0201  [0201]
R17064  10K  RESISTOR_0201  [0201]
R17065  10K  RESISTOR_0201  [0201]
R17066  10K  RESISTOR_0201  [0201]
R17067  10K  RESISTOR_0201  [0201]
R17068  10K  RESISTOR_0201  [0201]
R17069  10K  RESISTOR_0201  [0201]
R17070  10K  RESISTOR_0201  [0201]
R17071  10K  RESISTOR_0201  [0201]
R17072  10K  RESISTOR_0201  [0201]
R17073  10K  RESISTOR_0201  [0201]
R17074  10K  RESISTOR_0201  [0201]
R17075  10K  RESISTOR_0201  [0201]
R17076  10K  RESISTOR_0201  [0201]
R17077  10K  RESISTOR_0201  [0201]
R17078  10K  RESISTOR_0201  [0201]
R17079  10K  RESISTOR_0201  [0201]
R17080  10K  RESISTOR_0201  [0201]
R17081  10K  RESISTOR_0201  [0201]
R17082  10K  RESISTOR_0201  [0201]
R17083  10K  RESISTOR_0201  [0201]
R17084  10K  RESISTOR_0201  [0201]
R17085  10K  RESISTOR_0201  [0201]
R17086  10K  RESISTOR_0201  [0201]
R17087  10K  RESISTOR_0201  [0201]
R17088  10K  RESISTOR_0201  [0201]
R17089  10K  RESISTOR_0201  [0201]
R17090  10K  RESISTOR_0201  [0201]
R17091  10K  RESISTOR_0201  [0201]
R17092  10K  RESISTOR_0201  [0201]
R17093  10K  RESISTOR_0201  [0201]
R17094  10K  RESISTOR_0201  [0201]
R17095  10K  RESISTOR_0201  [0201]
R17096  10K  RESISTOR_0201  [0201]
R17097  10K  RESISTOR_0201  [0201]
R17098  10K  RESISTOR_0201  [0201]
R17099  10K  RESISTOR_0201  [0201]
R17100  10K  RESISTOR_0201  [0201]
R17101  10K  RESISTOR_0201  [0201]
R17102  10K  RESISTOR_0201  [0201]
R17103  10K  RESISTOR_0201  [0201]
R17104  10K  RESISTOR_0201  [0201]
R17105  10K  RESISTOR_0201  [0201]
R17106  10K  RESISTOR_0201  [0201]
R17107  10K  RESISTOR_0201  [0201]
R17108  10K  RESISTOR_0201  [0201]
R17109  10K  RESISTOR_0201  [0201]
R17110  10K  RESISTOR_0201  [0201]
R17111  10K  RESISTOR_0201  [0201]
R17112  10K  RESISTOR_0201  [0201]
R17113  10K  RESISTOR_0201  [0201]
R17114  10K  RESISTOR_0201  [0201]
R17115  10K  RESISTOR_0201  [0201]
R17116  10K  RESISTOR_0201  [0201]
R17117  10K  RESISTOR_0201  [0201]
R17118  10K  RESISTOR_0201  [0201]
R17119  10K  RESISTOR_0201  [0201]
R17120  10K  RESISTOR_0201  [0201]
R17121  10K  RESISTOR_0201  [0201]
R17122  10K  RESISTOR_0201  [0201]
R17123  10K  RESISTOR_0201  [0201]
R17124  10K  RESISTOR_0201  [0201]
R17125  10K  RESISTOR_0201  [0201]
R17126  10K  RESISTOR_0201  [0201]
R17127  10K  RESISTOR_0201  [0201]
R17128  10K  RESISTOR_0201  [0201]
R17129  10K  RESISTOR_0201  [0201]
R17130  10K  RESISTOR_0201  [0201]
R17131  10K  RESISTOR_0201  [0201]
R17132  10K  RESISTOR_0201  [0201]
R17133  10K  RESISTOR_0201  [0201]
R17134  10K  RESISTOR_0201  [0201]
R17135  10K  RESISTOR_0201  [0201]
R17136  10K  RESISTOR_0201  [0201]
R17137  10K  RESISTOR_0201  [0201]
R17138  10K  RESISTOR_0201  [0201]
R17139  10K  RESISTOR_0201  [0201]
R17140  10K  RESISTOR_0201  [0201]
R17141  10K  RESISTOR_0201  [0201]
R17142  10K  RESISTOR_0201  [0201]
R17143  10K  RESISTOR_0201  [0201]
R17144  10K  RESISTOR_0201  [0201]
R17145  10K  RESISTOR_0201  [0201]
R17146  10K  RESISTOR_0201  [0201]
R17147  10K  RESISTOR_0201  [0201]
R17148  10K  RESISTOR_0201  [0201]
R17149  10K  RESISTOR_0201  [0201]
R17150  10K  RESISTOR_0201  [0201]
R17151  10K  RESISTOR_0201  [0201]
R17152  10K  RESISTOR_0201  [0201]
R17153  10K  RESISTOR_0201  [0201]
R17154  10K  RESISTOR_0201  [0201]
R17155  10K  RESISTOR_0201  [0201]
R17156  10K  RESISTOR_0201  [0201]
R17157  10K  RESISTOR_0201  [0201]
R17158  10K  RESISTOR_0201  [0201]
R17159  10K  RESISTOR_0201  [0201]
R17160  10K  RESISTOR_0201  [0201]
R17161  10K  RESISTOR_0201  [0201]
R17162  10K  RESISTOR_0201  [0201]
R17163  10K  RESISTOR_0201  [0201]
R17164  10K  RESISTOR_0201  [0201]
R17165  10K  RESISTOR_0201  [0201]
R17166  10K  RESISTOR_0201  [0201]
R17167  10K  RESISTOR_0201  [0201]
R17168  10K  RESISTOR_0201  [0201]
R17169  10K  RESISTOR_0201  [0201]
R17170  10K  RESISTOR_0201  [0201]
R17171  10K  RESISTOR_0201  [0201]
R17172  10K  RESISTOR_0201  [0201]
R17173  10K  RESISTOR_0201  [0201]
R17174  10K  RESISTOR_0201  [0201]
R17175  10K  RESISTOR_0201  [0201]
R17176  10K  RESISTOR_0201  [0201]
R17177  10K  RESISTOR_0201  [0201]
R17178  10K  RESISTOR_0201  [0201]
R17179  10K  RESISTOR_0201  [0201]
R17180  10K  RESISTOR_0201  [0201]
R17181  10K  RESISTOR_0201  [0201]
R17182  10K  RESISTOR_0201  [0201]
R17183  10K  RESISTOR_0201  [0201]
R17184  10K  RESISTOR_0201  [0201]
R17185  10K  RESISTOR_0201  [0201]
R17186  10K  RESISTOR_0201  [0201]
R17187  10K  RESISTOR_0201  [0201]
R17188  10K  RESISTOR_0201  [0201]
R17189  10K  RESISTOR_0201  [0201]
R17190  10K  RESISTOR_0201  [0201]
R17191  10K  RESISTOR_0201  [0201]
R17192  10K  RESISTOR_0201  [0201]
R17193  10K  RESISTOR_0201  [0201]
R17194  10K  RESISTOR_0201  [0201]
R17195  10K  RESISTOR_0201  [0201]
R17196  10K  RESISTOR_0201  [0201]
R17197  10K  RESISTOR_0201  [0201]
R17198  10K  RESISTOR_0201  [0201]
R17199  10K  RESISTOR_0201  [0201]
R17200  10K  RESISTOR_0201  [0201]
R17201  10K  RESISTOR_0201  [0201]
R17202  10K  RESISTOR_0201  [0201]
R17203  10K  RESISTOR_0201  [0201]
R17204  10K  RESISTOR_0201  [0201]
R17205  10K  RESISTOR_0201  [0201]
R17206  10K  RESISTOR_0201  [0201]
R17207  10K  RESISTOR_0201  [0201]
R17208  10K  RESISTOR_0201  [0201]
R17209  10K  RESISTOR_0201  [0201]
R17210  10K  RESISTOR_0201  [0201]
R17211  10K  RESISTOR_0201  [0201]
R17212  10K  RESISTOR_0201  [0201]
R17213  10K  RESISTOR_0201  [0201]
R17214  10K  RESISTOR_0201  [0201]
R17215  10K  RESISTOR_0201  [0201]
R17216  10K  RESISTOR_0201  [0201]
R17217  10K  RESISTOR_0201  [0201]
R17218  10K  RESISTOR_0201  [0201]
R17219  10K  RESISTOR_0201  [0201]
R17220  10K  RESISTOR_0201  [0201]
R17221  10K  RESISTOR_0201  [0201]
R17222  10K  RESISTOR_0201  [0201]
R17223  10K  RESISTOR_0201  [0201]
R17224  10K  RESISTOR_0201  [0201]
R17225  10K  RESISTOR_0201  [0201]
R17226  10K  RESISTOR_0201  [0201]
R17227  10K  RESISTOR_0201  [0201]
R17228  10K  RESISTOR_0201  [0201]
R17229  10K  RESISTOR_0201  [0201]
R17230  10K  RESISTOR_0201  [0201]
R17231  10K  RESISTOR_0201  [0201]
R17232  10K  RESISTOR_0201  [0201]
R17233  10K  RESISTOR_0201  [0201]
R17234  10K  RESISTOR_0201  [0201]
R17235  10K  RESISTOR_0201  [0201]
R17236  10K  RESISTOR_0201  [0201]
R17237  10K  RESISTOR_0201  [0201]
R17238  10K  RESISTOR_0201  [0201]
R17239  10K  RESISTOR_0201  [0201]
R17240  10K  RESISTOR_0201  [0201]
R17241  10K  RESISTOR_0201  [0201]
R17242  10K  RESISTOR_0201  [0201]
R17243  10K  RESISTOR_0201  [0201]
R17244  10K  RESISTOR_0201  [0201]
R17245  10K  RESISTOR_0201  [0201]
R17246  10K  RESISTOR_0201  [0201]
R17247  10K  RESISTOR_0201  [0201]
R17248  10K  RESISTOR_0201  [0201]
R17249  10K  RESISTOR_0201  [0201]
R17250  10K  RESISTOR_0201  [0201]
R17251  10K  RESISTOR_0201  [0201]
R17252  10K  RESISTOR_0201  [0201]
R17253  10K  RESISTOR_0201  [0201]
R17254  10K  RESISTOR_0201  [0201]
R17255  10K  RESISTOR_0201  [0201]
R17256  10K  RESISTOR_0201  [0201]
R17257  10K  RESISTOR_0201  [0201]
R17258  10K  RESISTOR_0201  [0201]
R17259  10K  RESISTOR_0201  [0201]
R17260  10K  RESISTOR_0201  [0201]
R17261  10K  RESISTOR_0201  [0201]
R17262  10K  RESISTOR_0201  [0201]
R17263  10K  RESISTOR_0201  [0201]
R17264  10K  RESISTOR_0201  [0201]
R17265  10K  RESISTOR_0201  [0201]
R17266  10K  RESISTOR_0201  [0201]
R17267  10K  RESISTOR_0201  [0201]
R17268  10K  RESISTOR_0201  [0201]
R17269  10K  RESISTOR_0201  [0201]
R17270  10K  RESISTOR_0201  [0201]
R17271  10K  RESISTOR_0201  [0201]
R17272  10K  RESISTOR_0201  [0201]
R17273  10K  RESISTOR_0201  [0201]
R17274  10K  RESISTOR_0201  [0201]
R17275  10K  RESISTOR_0201  [0201]
R17276  10K  RESISTOR_0201  [0201]
R17277  10K  RESISTOR_0201  [0201]
R17278  10K  RESISTOR_0201  [0201]
R17279  10K  RESISTOR_0201  [0201]
R17280  10K  RESISTOR_0201  [0201]
R17281  10K  RESISTOR_0201  [0201]
R17282  10K  RESISTOR_0201  [0201]
R17283  10K  RESISTOR_0201  [0201]
R17284  10K  RESISTOR_0201  [0201]
R17285  10K  RESISTOR_0201  [0201]
R17286  10K  RESISTOR_0201  [0201]
R17287  10K  RESISTOR_0201  [0201]
R17288  10K  RESISTOR_0201  [0201]
R17289  10K  RESISTOR_0201  [0201]
R17290  10K  RESISTOR_0201  [0201]
R17291  10K  RESISTOR_0201  [0201]
R17292  10K  RESISTOR_0201  [0201]
R17293  10K  RESISTOR_0201  [0201]
R17294  10K  RESISTOR_0201  [0201]
R17295  10K  RESISTOR_0201  [0201]
R17296  10K  RESISTOR_0201  [0201]
R17297  10K  RESISTOR_0201  [0201]
R17298  10K  RESISTOR_0201  [0201]
R17299  10K  RESISTOR_0201  [0201]
R17300  10K  RESISTOR_0201  [0201]
R17301  10K  RESISTOR_0201  [0201]
R17302  10K  RESISTOR_0201  [0201]
R17303  10K  RESISTOR_0201  [0201]
R17304  10K  RESISTOR_0201  [0201]
R17305  10K  RESISTOR_0201  [0201]
R17306  10K  RESISTOR_0201  [0201]
R17307  10K  RESISTOR_0201  [0201]
R17308  10K  RESISTOR_0201  [0201]
R17309  10K  RESISTOR_0201  [0201]
R17310  10K  RESISTOR_0201  [0201]
R17311  10K  RESISTOR_0201  [0201]
R17312  10K  RESISTOR_0201  [0201]
R17313  10K  RESISTOR_0201  [0201]
R17314  10K  RESISTOR_0201  [0201]
R17315  10K  RESISTOR_0201  [0201]
R17316  10K  RESISTOR_0201  [0201]
R17317  10K  RESISTOR_0201  [0201]
R17318  10K  RESISTOR_0201  [0201]
R17319  10K  RESISTOR_0201  [0201]
R17320  10K  RESISTOR_0201  [0201]
R17321  10K  RESISTOR_0201  [0201]
R17322  10K  RESISTOR_0201  [0201]
R17323  10K  RESISTOR_0201  [0201]
R17324  10K  RESISTOR_0201  [0201]
R17325  10K  RESISTOR_0201  [0201]
R17326  10K  RESISTOR_0201  [0201]
R17327  10K  RESISTOR_0201  [0201]
R17328  10K  RESISTOR_0201  [0201]
R17329  10K  RESISTOR_0201  [0201]
R17330  10K  RESISTOR_0201  [0201]
R17331  10K  RESISTOR_0201  [0201]
R17332  10K  RESISTOR_0201  [0201]
R17333  10K  RESISTOR_0201  [0201]
R17334  10K  RESISTOR_0201  [0201]
R17335  10K  RESISTOR_0201  [0201]
R17336  10K  RESISTOR_0201  [0201]
R17337  10K  RESISTOR_0201  [0201]